# EAGLE board LG08.v1.0.2 (EAGLE 7.5.0)
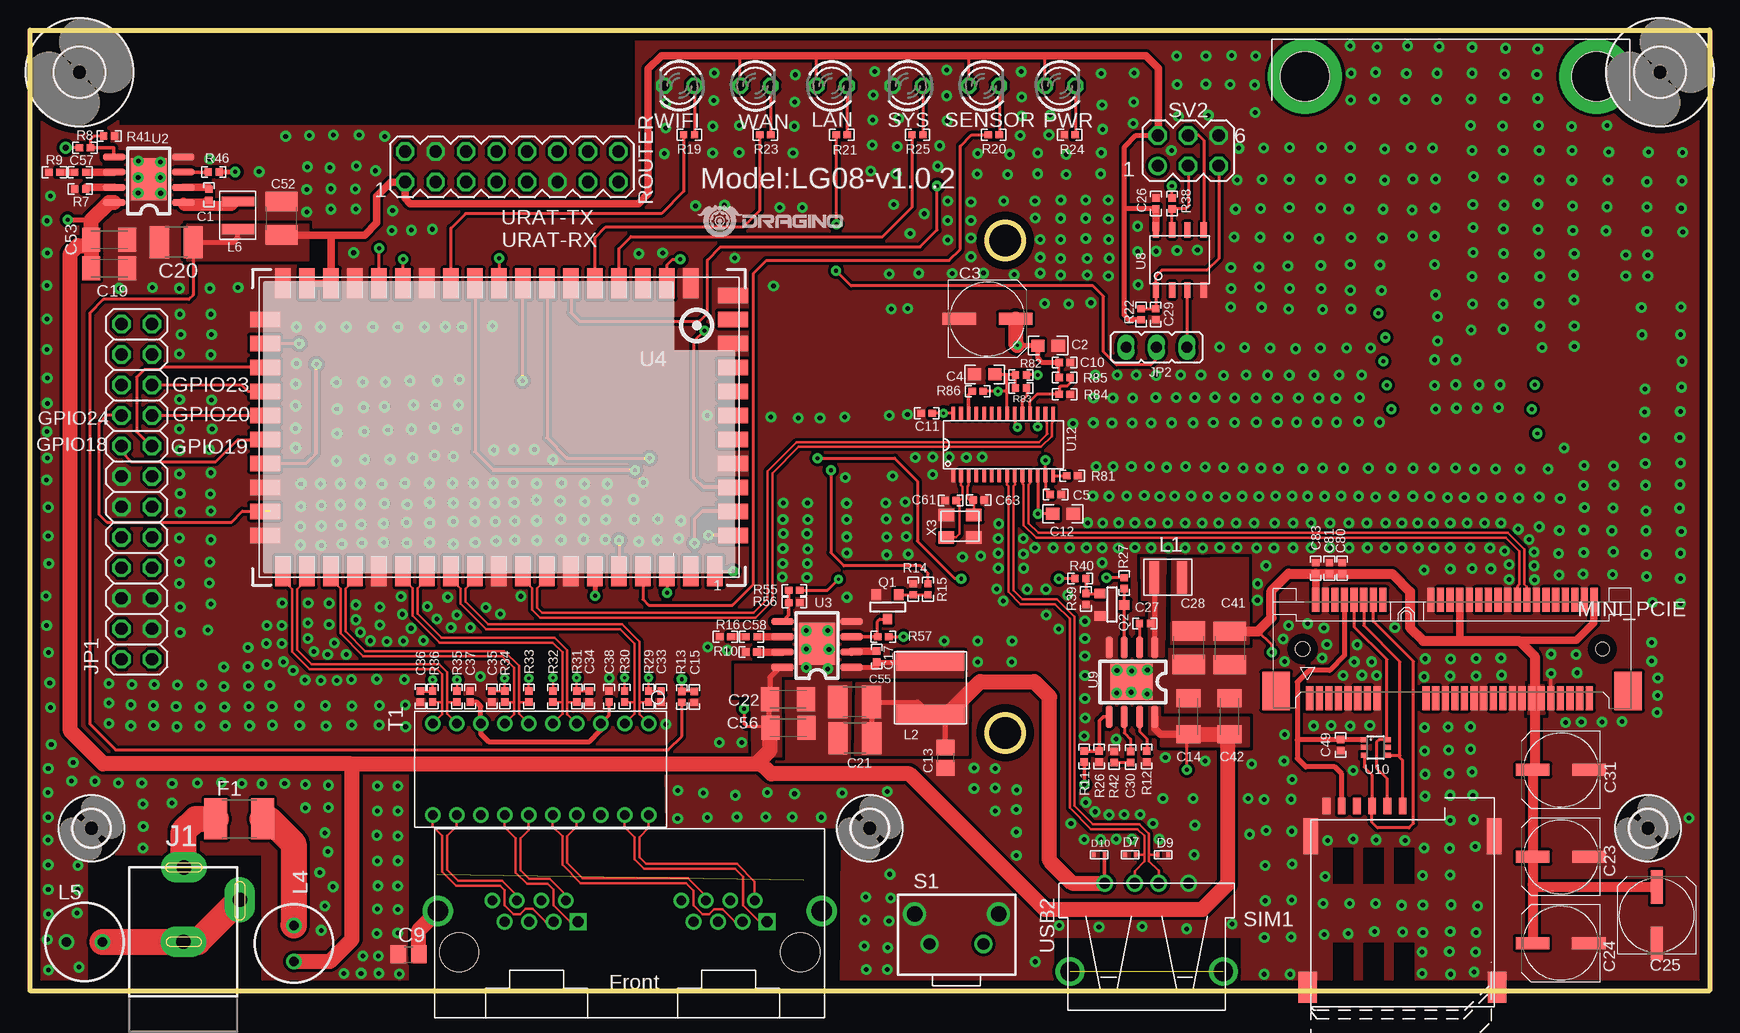
[diagram p6: board, top side]
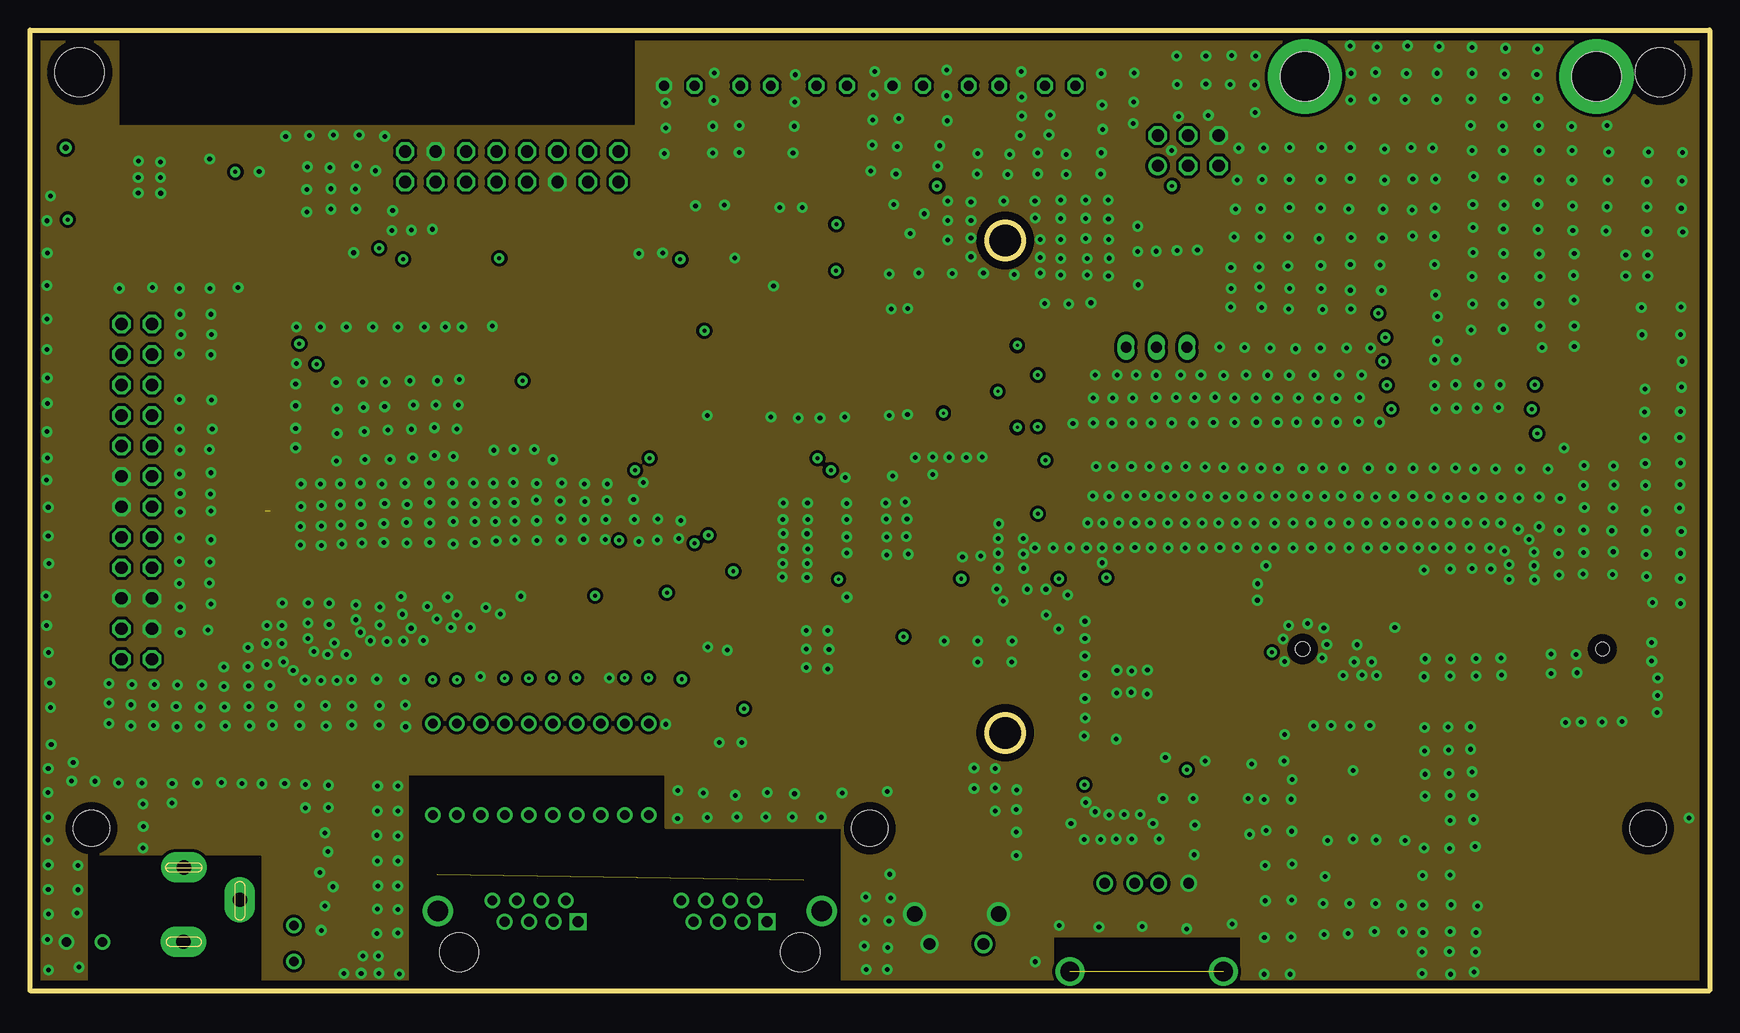
[diagram p7: board, inner layer Route2]
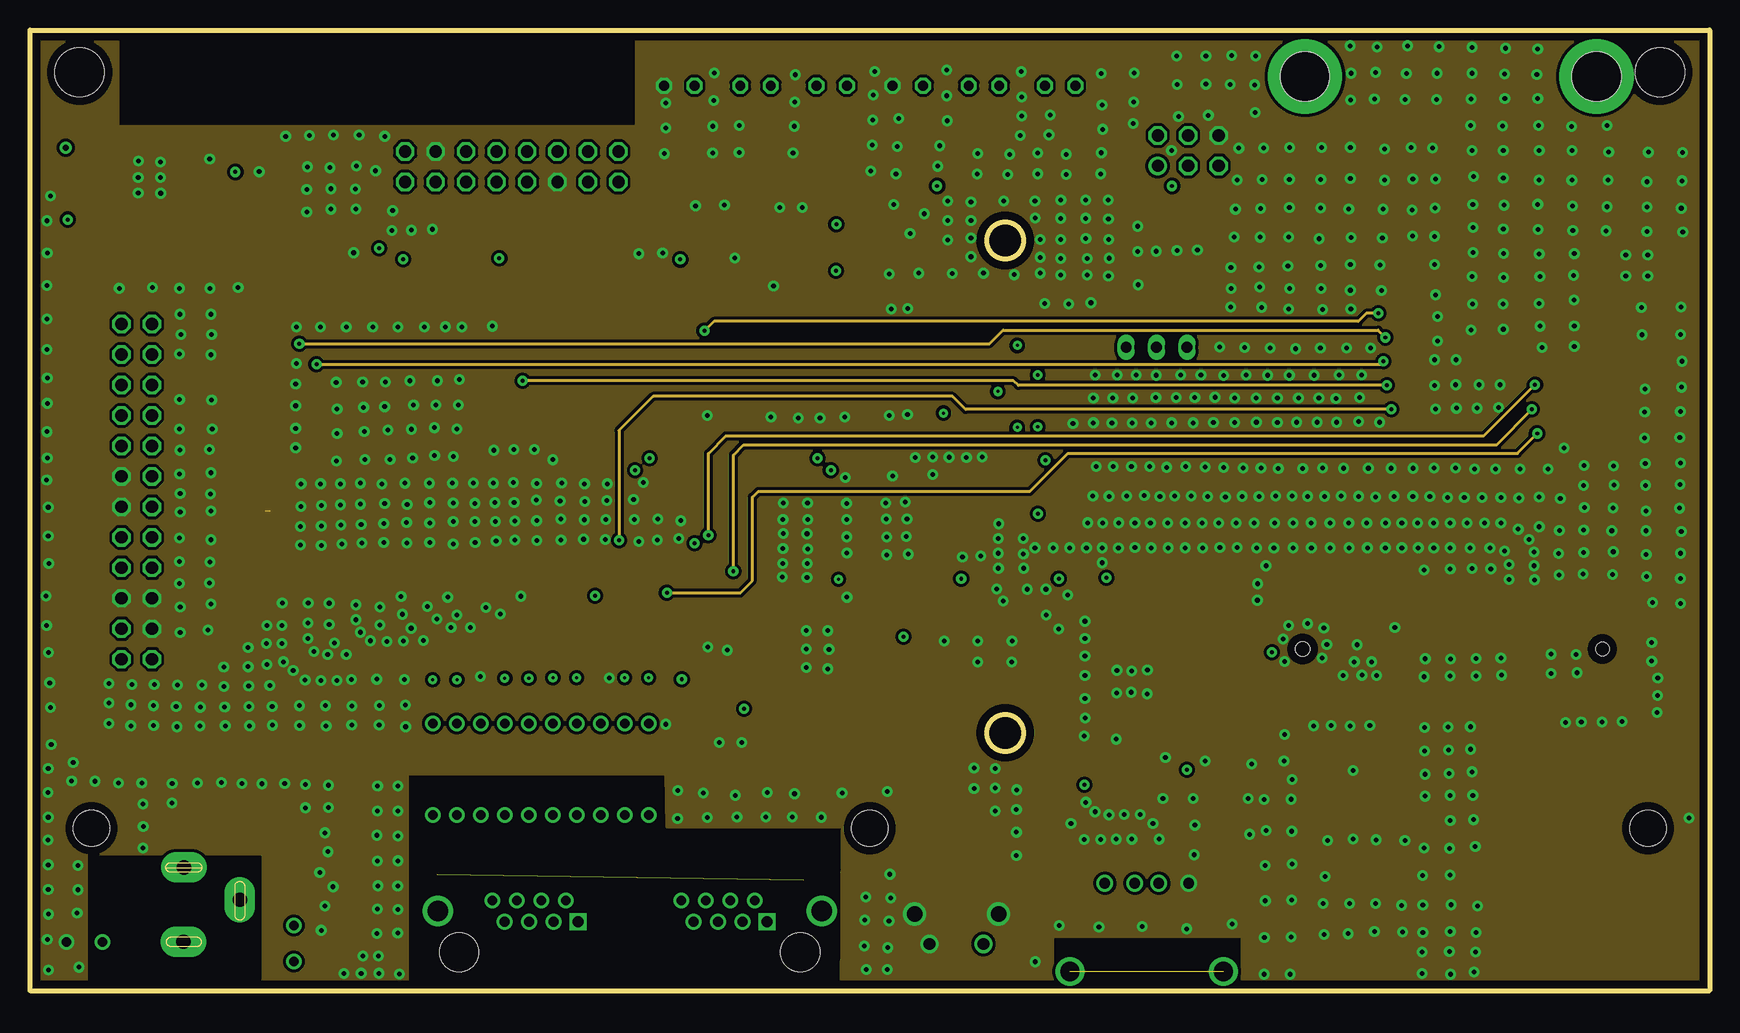
[diagram p8: board, inner layer Route15]
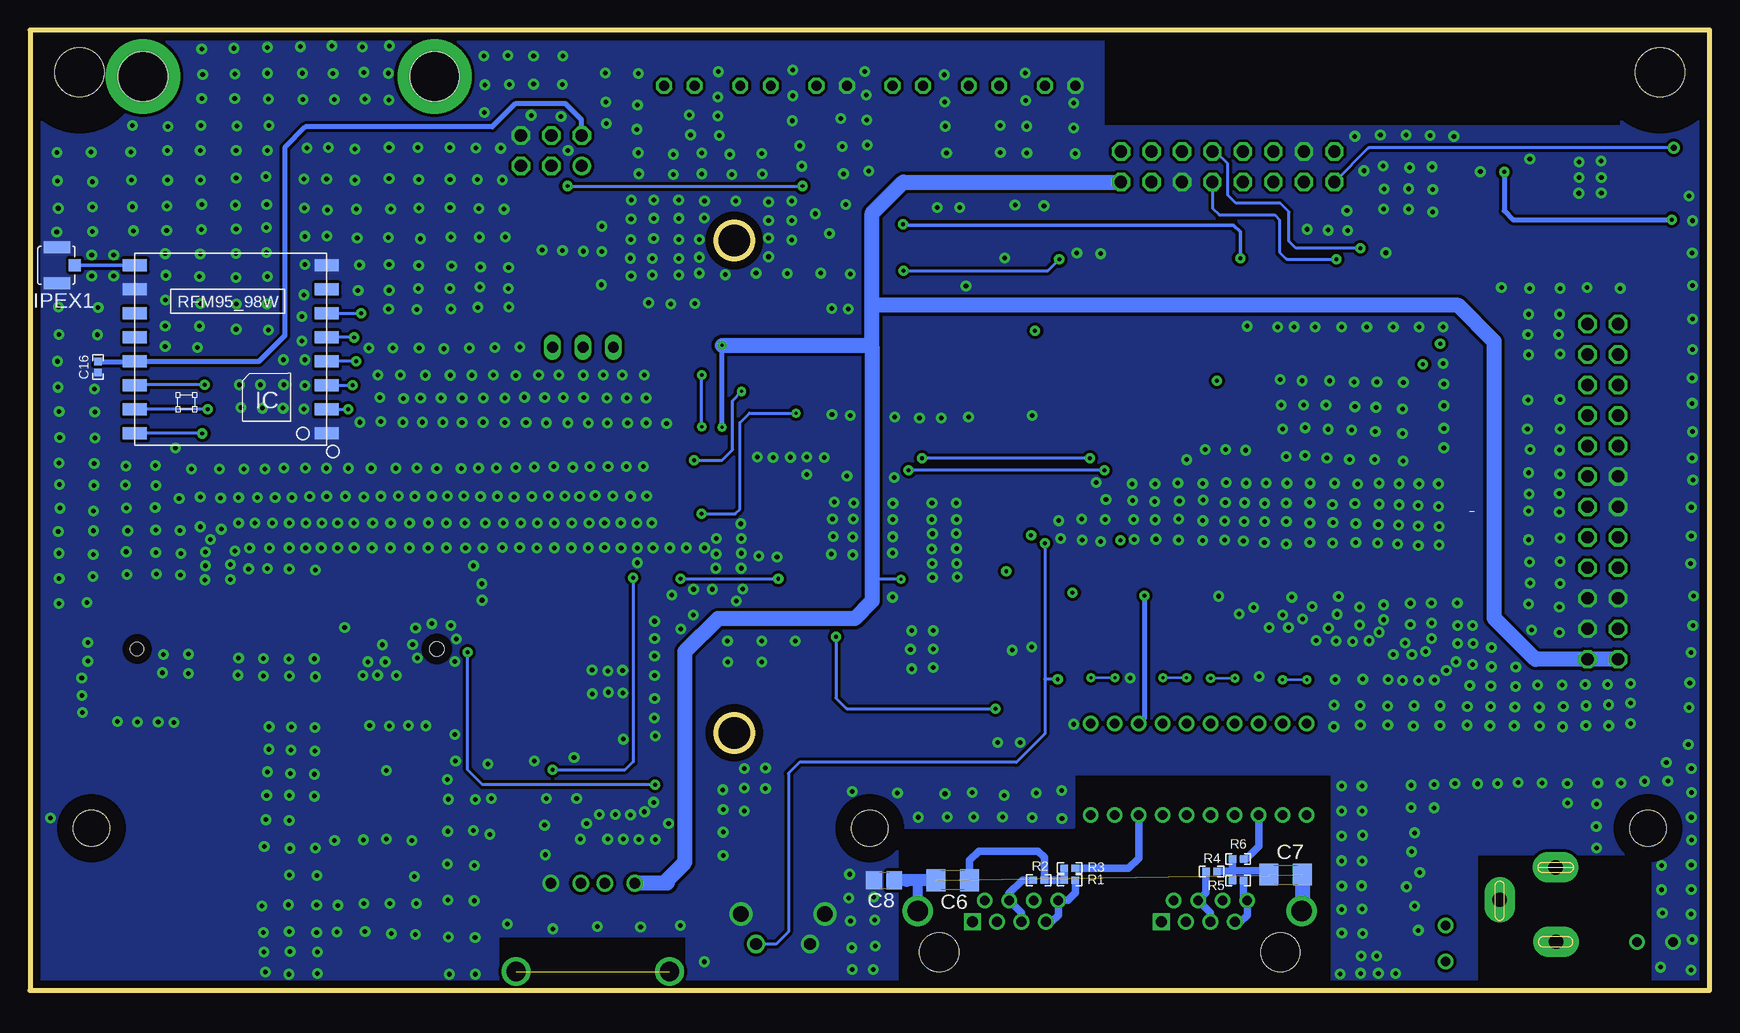
[diagram p9: board, bottom side, seen from below]

Size 140 x 80.05 mm. Coordinates in mm from the lower left corner, seen from the top.
Outline: 0,0 140,0 140,80.05 0,80.05 0,0
Outline: circle at 81.28,21.48 radius 1.52
Outline: circle at 81.28,62.5 radius 1.52
Copper layers (1*2+15*16): Top 0.035mm / dielectric 1.5mm / Route2 0.035mm / dielectric 0.15mm / Route15 0.035mm / dielectric 0.2mm / Bottom 0.035mm
Design rules "default *": minimum track width 5mil, minimum drill 10mil, track to track 8mil, track to pad 8mil, pad to pad 8mil, via to via 10mil, smd to smd 8mil, copper to edge 26mil, drill to drill 10mil, minimum pad ring 10mil, minimum via ring 10mil, stop-mask expansion 1mil, vias tented up to drill 30mil, thermal gap 10mil
Net classes: 0 default: clearance 0.205 mm; 1 2layer-50ohm: width 1 mm, clearance 0.2 mm; 2 gnd: width 0.305 mm, drill 0.33 mm, clearance 0.254 mm; 3 usbvcc: width 0.508 mm, drill 0.61 mm, clearance 0.254 mm; 4 aref: width 0.406 mm, drill 0.61 mm, clearance 0.254 mm; 6 usbtrace-4layer: width 0.191 mm, clearance 0.203 mm

## Footprints (pad centres in the part's own frame; a part is rotated, then mirrored left to right if it is on the bottom)
C0402 = smd 0.61 x 0.61: 1 -0.457,0; 2 0.457,0
C0603 = smd 1.1 x 1: 1 -0.85,0; 2 0.85,0
UD-6,3X5,8_NICHICON = smd 2.8 x 1: + 2.35,0; - -2.35,0
C1206 = smd 1.6 x 1.8: 1 -1.4,0; 2 1.4,0
C0805 = smd 1.3 x 1.5: 1 -0.85,0; 2 0.85,0
C1206K = smd 1.5 x 2: 1 -1.5,0; 2 1.5,0
C1210 = smd 1.6 x 2.7: 1 -1.4,0; 2 1.4,0
SOD−923 = smd 0.3 x 0.4: P$1 -0.45,0; P$2 0.45,0
L1812 = smd 1.9 x 3.4: 1 -1.95,0; 2 1.95,0
I-PEX = smd 1 x 2.2: GND -1.65,-0.27; GND1 1.35,-0.27 | smd 1 x 1: SIG -0.15,-1.77
POWER_JACK_SLOT = drill 1.2 pad 2.54 long: GND@1 0,0; GND@2 4.7,3.5; PWR 0.04,6.2
ETHERNET-1X2 = drill 0.94 pad 1.27 square: 1-1 4.305,-2.54; 2-1 -11.445,-2.54 | drill 0.8: 1-2 5.325,-4.32; 1-3 6.345,-2.54; 1-4 7.365,-4.32; 1-5 8.385,-2.54; 1-6 9.405,-4.32; 1-7 10.425,-2.54; 1-8 11.445,-4.32; 2-2 -10.425,-4.32; 2-3 -9.405,-2.54; 2-4 -8.385,-4.32; 2-5 -7.365,-2.54; 2-6 -6.345,-4.32; 2-7 -5.325,-2.54; 2-8 -4.305,-4.32 | drill 1.7: S1 16,-3.43; S2 -16,-3.43 | hole 3.25: -14.225,0; 14.225,0
2X12 = drill 1.016 octagon: 1 -13.97,-1.27; 2 -13.97,1.27; 3 -11.43,-1.27; 4 -11.43,1.27; 5 -8.89,-1.27; 6 -8.89,1.27; 7 -6.35,-1.27; 8 -6.35,1.27; 9 -3.81,-1.27; 10 -3.81,1.27; 11 -1.27,-1.27; 12 -1.27,1.27; 13 1.27,-1.27; 14 1.27,1.27; 15 3.81,-1.27; 16 3.81,1.27; 17 6.35,-1.27; 18 6.35,1.27; 19 8.89,-1.27; 20 8.89,1.27; 21 11.43,-1.27; 22 11.43,1.27; 23 13.97,-1.27; 24 13.97,1.27
JP2 = drill 0.914 long: 1 -2.54,0; 2 0,0; 3 2.54,0
SWPA3010S = smd 0.8 x 2.7: P$1 -1.15,0; P$2 1.15,0
SWPA6028S = smd 5.7 x 1.7: P$1 0,2.25; P$2 0,-2.25
BS11 = drill 0.8: 1 -1.5,0; 2 1.5,0
LED3MM = drill 0.813 octagon: A -1.27,0; K 1.27,0
679105700 = smd 0.6 x 2: 1 0.6,-4.1; 2 1.1,4.1; 3 1.4,-4.1; 4 1.9,4.1; 5 2.2,-4.1; 6 2.7,4.1; 7 3,-4.1; 8 3.5,4.1; 9 3.8,-4.1; 10 4.3,4.1; 11 4.6,-4.1; 12 5.1,4.1; 13 5.4,-4.1; 14 5.9,4.1; 15 6.2,-4.1; 16 6.7,4.1; 17 10.3,-4.1; 18 10.7,4.1; 19 11.1,-4.1; 20 11.5,4.1; 21 11.9,-4.1; 22 12.3,4.1; 23 12.7,-4.1; 24 13.1,4.1; 25 13.5,-4.1; 26 13.9,4.1; 27 14.3,-4.1; 28 14.7,4.1; 29 15.1,-4.1; 30 15.5,4.1; 31 15.9,-4.1; 32 16.3,4.1; 33 16.7,-4.1; 34 17.1,4.1; 35 17.5,-4.1; 36 17.9,4.1; 37 18.3,-4.1; 38 18.7,4.1; 39 19.1,-4.1; 40 19.5,4.1; 41 19.9,-4.1; 42 20.3,4.1; 43 20.7,-4.1; 44 21.1,4.1; 45 21.5,-4.1; 46 21.9,4.1; 47 22.3,-4.1; 48 22.7,4.1; 49 23.1,-4.1; 50 23.5,4.1; 51 23.9,-4.1; 52 24.3,4.1 | drill 4.09 pad 6.2: 53 0.2,47.7; 54 24.5,47.7 | smd 2.3 x 3.2: M1 27.15,-3.5; M2 -2.2,-3.5 | hole 1.2: 0,0 | hole 1.1: 25,0 | hole 4.09: 0.2,47.7; 24.5,47.7
SOT-23 = smd 0.787 x 0.889: 1 0,-1.016; 2 -0.95,1.016; 3 0.95,1.016
R0402 = smd 0.61 x 0.61: 1 -0.457,0; 2 0.457,0
MA08-2 = drill 1.016 octagon: 1 -8.89,-1.27; 2 -8.89,1.27; 3 -6.35,-1.27; 4 -6.35,1.27; 5 -3.81,-1.27; 6 -3.81,1.27; 7 -1.27,-1.27; 8 -1.27,1.27; 9 1.27,-1.27; 10 1.27,1.27; 11 3.81,-1.27; 12 3.81,1.27; 13 6.35,-1.27; 14 6.35,1.27; 15 8.89,-1.27; 16 8.89,1.27
SWITCH_6X6X5 = drill 0.991 pad 1.524: 1 -2.25,0; 2 2.25,0 | drill 1.295 pad 1.905: 3 3.5,2.5; 4 -3.5,2.5
SIM-MICRO-PUSH = smd 0.65 x 1.35: CLK 7.91,15.105; GND 1.56,15.105; IO 6.64,15.105; RST 5.37,15.105; VCC 2.83,15.105; VPP 4.1,15.105 | smd 1.55 x 2.6: P$1 0,0; P$2 15.8,0 | smd 1.2 x 3: P$3 15.55,12.58; P$4 0.25,12.58
MA03-2 = drill 1.016: 1 -2.54,-1.27 | drill 1.016 octagon: 2 -2.54,1.27; 3 0,-1.27; 4 0,1.27; 5 2.54,-1.27; 6 2.54,1.27
RIONET_H2038 = drill 0.8: 1 -3.81,9; 2 -3.81,7; 3 -3.81,5; 4 -3.81,3; 5 -3.81,1; 6 -3.81,-1; 7 -3.81,-3; 8 -3.81,-5; 9 -3.81,-7; 10 -3.81,-9; 11 3.81,-9; 12 3.81,-7; 13 3.81,-5; 14 3.81,-3; 15 3.81,-1; 16 3.81,1; 17 3.81,3; 18 3.81,5; 19 3.81,7; 20 3.81,9
RFM92_93W = smd 2 x 1: 1 -8,7; 2 -8,5; 3 -8,3; 4 -8,1; 5 -8,-1; 6 -8,-3; 7 -8,-5; 8 -8,-7; 9 8,-7; 10 8,-5; 11 8,-3; 12 8,-1; 13 8,1; 14 8,3; 15 8,5; 16 8,7
RT8250-SOP8 = smd 1.88 x 0.61: 1 -1.219,0; 2 -1.219,-1.27; 3 -1.219,-2.54; 4 -1.219,-3.81; 5 4.547,-3.81; 6 4.547,-2.54; 7 4.547,-1.27; 8 4.547,0 | smd 2.997 x 3.505: 9 1.651,-1.956
HE-4025 = smd 1.3 x 2.5: 1 -18,12; 2 -16,12; 3 -14,12; 4 -12,12; 5 -10,12; 6 -8,12; 7 -6,12; 8 -4,12; 9 -2,12; 10 0,12; 11 2,12; 12 4,12; 13 6,12; 14 8,12; 15 10,12; 16 12,12; 17 14,12; 18 16,12; 19 18,12; 30 18,-12; 31 16,-12; 32 14,-12; 33 12,-12; 34 10,-12; 35 8,-12; 36 6,-12; 37 4,-12; 38 2,-12; 39 0,-12; 40 -2,-12; 41 -4,-12; 42 -6,-12; 43 -8,-12; 44 -10,-12; 45 -12,-12; 46 -14,-12; 47 -16,-12 | smd 2.5 x 1.3: 20 19.5,9; 21 19.5,7; 22 19.5,5; 23 19.5,3; 24 19.5,1; 25 19.5,-1; 26 19.5,-3; 27 19.5,-5; 28 19.5,-7; 29 19.5,-9; 48 -19.5,-11; 49 -19.5,-9; 50 -19.5,-7; 51 -19.5,-5; 52 -19.5,-3; 53 -19.5,-1; 54 -19.5,1; 55 -19.5,3; 56 -19.5,5; 57 -19.5,7; 58 -19.5,9
S8S1 = smd 1.27 x 0.51: 1 -0.54,5.47; 2 -0.54,4.11; 3 -0.54,2.84; 4 -0.54,1.48; 5 4.46,1.48; 6 4.46,2.84; 7 4.46,4.11; 8 4.46,5.47
SOT363 = smd 0.42 x 0.6: 1 -0.65,-0.95; 2 0,-0.95; 3 0.65,-0.95; 4 0.65,0.95; 5 0,0.95; 6 -0.65,0.95
USB_HUB_FE1.1S = smd 0.3 x 1.1: 1 -4.16,-2.6; 2 -3.52,-2.6; 3 -2.88,-2.6; 4 -2.24,-2.6; 5 -1.6,-2.6; 6 -0.96,-2.6; 7 -0.32,-2.6; 8 0.32,-2.6; 9 0.96,-2.6; 10 1.6,-2.6; 11 2.24,-2.6; 12 2.88,-2.6; 13 3.52,-2.6; 14 4.16,-2.6; 15 4.16,2.62; 16 3.52,2.62; 17 2.88,2.62; 18 2.24,2.62; 19 1.6,2.62; 20 0.96,2.62; 21 0.32,2.62; 22 -0.32,2.62; 23 -0.96,2.62; 24 -1.6,2.62; 25 -2.24,2.62; 26 -2.88,2.62; 27 -3.52,2.62; 28 -4.16,2.62
3,0 = hole 3: 0,0
4,1 = hole 4.1: 0,0
USB_C42562 = drill 0.9: 1 -3.5,5.29; 2 -1,5.29; 3 1,5.29; 4 3.5,5.29 | drill 1.6: 5 -6.4,-2.06; 6 6.4,-2.06
SMARTPRJ_CRYSTAL-3.2-2.5 = smd 1.3 x 1.05: 1 -1.15,-0.925; 2 1.15,-0.925; 3 1.15,0.925; 4 -1.15,0.925

## Placement (x,y rotation side)
C1  0.1u,50v  [C0402]  14.91,66.32 270 top
C2  10uf 10v  [C0603]  84.86,53.76 0 top
C3  100uF 16v TBD  [UD-6,3X5,8_NICHICON]  79.81,55.97 0 top
C4  10uf 10v  [C0603]  79.58,51.35 180 top
C5  0.1u  [C0402]  85.5,41.34 0 top
C6  1000pF,2kv  [C1206]  63.09,9.2 180 bottom
C7  1000pF,2kv  [C1206]  35.34,9.67 0 bottom
C8  0.1u,100V  [C0805]  68.79,9.19 0 bottom
C9  0.1u,100V  [C0805]  31.55,3.01 0 top
C10  0.1u  [C0402]  86.24,52.35 0 top
C11  0.1u  [C0402]  74.75,48.12 180 top
C12  10uf 10v  [C0603]  86.1,39.74 0 top
C13  10u,10V  [C0805]  76.3,19.4 270 top
C14  10uf,50v  [C1206K]  96.55,22.85 90 top
C15  100nF  [C0402]  55.37,24.48 90 top
C16  0.1uF 10V  [C0402]  134.34,51.96 90 bottom
C17  0.1u,50v  [C0402]  70.59,27.83 270 top
C19  10uf,50v  [C1206K]  6.6,60.2 0 top
C20  22uF,10v  [C1210]  12.19,62.36 180 top
C21  22uf,10v  [C1210]  68.76,21.03 180 top
C22  10uf,50v  [C1206K]  63.2,24.28 0 top
C23  470uF,JLC-C116423  [UD-6,3X5,8_NICHICON]  127.61,11.15 180 top
C24  470uF,JLC-C116423  [UD-6,3X5,8_NICHICON]  127.59,3.96 180 top
C25  470uF,JLC-C116423  [UD-6,3X5,8_NICHICON]  135.59,6.27 90 top
C26  0.1uF,25V  [C0402]  93.86,65.6 270 top
C27  0.1u,50v  [C0402]  92.94,30.6 0 top
C28  22fu,10v  [C1210]  96.57,28.57 270 top
C29  100pF  [C0402]  93.83,56.36 90 top
C30  2.7nf  [C0402]  91.75,19.48 90 top
C31  470uF,JLC-C116423  [UD-6,3X5,8_NICHICON]  127.61,18.38 180 top
C33  0.1u 10v  [C0402]  52.61,24.5 270 top
C34  0.1u 10v  [C0402]  46.61,24.5 270 top
C35  0.1u 10v  [C0402]  38.51,24.5 270 top
C36  0.1u 10v  [C0402]  32.54,24.5 270 top
C37  0.1u  [C0402]  36.68,24.5 90 top
C38  0.1u  [C0402]  48.26,24.5 90 top
C41  22uf,10v  [C1210]  100,28.54 270 top
C42  10uf,50v  [C1206K]  99.98,22.85 90 top
C49  0.1u  [C0402]  109.25,20.47 270 top
C52  22uF,10v  [C1210]  20.98,64.37 90 top
C53  10uf,50v  [C1206K]  6.6,62.56 0 top
C55  22fu,10v  [C1210]  68.74,24.05 180 top
C56  10uf,50v  [C1206K]  63.22,21.89 0 top
C57  2.7nf  [C0402]  4.19,68.2 0 top
C58  2.7nf  [C0402]  60.15,29.48 0 top
C61  18pF  [C0402]  76.76,40.86 0 top
C63  18pF  [C0402]  79.09,40.88 180 top
C80  33pf  [C0402]  109.38,35.2 90 top
C81  10pf  [C0402]  108.31,35.2 90 top
C83  33pf  [C0402]  107.17,35.2 90 top
D7  ESD7951ST5G  [SOD−923]  91.72,11.32 0 top
D9  ESD7951ST5G  [SOD−923]  94.44,11.32 180 top
D10  ESD7951ST5G  [SOD−923]  89.13,11.32 0 top
F1  2A  [L1812]  17.44,14.32 0 top
IPEX1  I-PEX  [I-PEX]  138.03,60.6 90 bottom
J1  POWER_JACKSLT  [POWER_JACK_SLOT]  12.79,4.07 0 top
J2  ETHERNET_2PORT  [ETHERNET-1X2]  49.99,3.2 180 top
JP1  [2X12]  8.9,41.58 90 top
JP2  [JP2]  93.91,53.61 0 top
L1  4.7uH /SWPA3015S4R7MT  [SWPA3010S]  94.87,34.44 0 top
L2  6.8uH / SWPA6045S6R8MT  [SWPA6028S]  75.06,25.24 0 top
L4  bead  [BS11]  22,3.93 90 top
L5  bead  [BS11]  4.55,4.06 0 top
L6  4.7uH /SWPA3015S4R7MT  [SWPA3010S]  17.32,64.59 270 top
LAN  GREEN  [LED3MM]  66.82,75.4 0 top
MINI_PCIE  f5521gw  [679105700]  106.07,28.47 0 top
PWR  GREEN  [LED3MM]  85.87,75.4 0 top
Q1  BSS138-7-F  [SOT-23]  71.48,31.97 0 top
Q2  BSS138-7-F  [SOT-23]  90.2,32.15 90 top
R1  75  [R0402]  53.32,9.2 0 bottom
R2  75  [R0402]  55.91,9.2 180 bottom
R3  75  [R0402]  53.32,10.2 180 bottom
R4  75  [R0402]  41.51,9.93 180 bottom
R5  75  [R0402]  39.3,9.16 0 bottom
R6  75  [R0402]  39.3,10.97 180 bottom
R7  180K  [R0402]  4.19,66.8 180 top
R8  75K 1%  [R0402]  4.57,70.23 180 top
R9  16K 1%  [R0402]  2.03,68.2 0 top
R10  180K  [R0402]  60.12,28.21 180 top
R11  75K 1%  [R0402]  87.89,19.5 270 top
R12  180K  [R0402]  93.09,19.5 270 top
R13  330  [R0402]  54.33,24.48 90 top
R14  47K,NL  [R0402]  73.64,33.45 270 top
R15  4.7k  [R0402]  74.86,33.45 270 top
R16  24K  [R0402]  57.97,29.48 180 top
R19  270  [R0402]  54.94,71.32 0 top
R20  330  [R0402]  80.34,71.32 0 top
R21  330  [R0402]  67.66,71.32 0 top
R22  10K  [R0402]  92.64,56.36 270 top
R23  330  [R0402]  61.28,71.32 0 top
R24  330  [R0402]  86.68,71.32 0 top
R25  270  [R0402]  73.98,71.32 0 top
R26  24K 1%  [R0402]  89.13,19.5 90 top
R27  100K  [R0402]  91.21,33.95 90 top
R29  49.9  [R0402]  51.57,24.5 90 top
R30  49.9  [R0402]  49.56,24.5 90 top
R31  49.9  [R0402]  45.57,24.5 90 top
R32  49.9  [R0402]  43.59,24.5 90 top
R33  49.9  [R0402]  41.58,24.5 90 top
R34  49.9  [R0402]  39.58,24.5 90 top
R35  49.9  [R0402]  35.59,24.5 90 top
R36  49.9  [R0402]  33.56,24.5 90 top
R38  0R  [R0402]  95.2,65.6 270 top
R39  47K,NL  [R0402]  88.01,32.63 90 top
R40  4.7k  [R0402]  87.56,34.34 0 top
R41  24K 1%  [R0402]  6.61,71.21 180 top
R42  16K  [R0402]  90.38,19.48 90 top
R46  100K  [R0402]  15.32,68.23 180 top
R55  53.6K 1%  [R0402]  63.71,33.37 0 top
R56  10K 1%  [R0402]  63.71,32.33 180 top
R57  100K  [R0402]  71.12,29.48 0 top
R81  2.7K 1%  [R0402]  86.87,42.9 180 top
R82  100k  [R0402]  82.61,51.31 180 top
R83  100k  [R0402]  82.61,50.22 180 top
R84  100k  [R0402]  86.26,49.69 180 top
R85  47K  [R0402]  86.24,51.08 180 top
R86  100k  [R0402]  78.99,49.95 0 top
ROUTER  [MA08-2]  40.16,68.65 0 top
S1  [SWITCH_6X6X5]  77.23,3.89 0 top
SENSOR  GREEN  [LED3MM]  79.52,75.4 0 top
SIM1  SIM_CARD_CON_6MICRO  [SIM-MICRO-PUSH]  106.51,0.27 0 top
SV2  [MA03-2]  96.55,70 0 top
SYS  GREEN  [LED3MM]  73.17,75.4 180 top
T1  RJ45_TRANSFORMER_HST2038DR  [RIONET_H2038]  42.57,18.44 270 top
U1  RFM92_93W  [RFM92_93W]  123.27,53.44 180 bottom
U2  RT7272  [RT8250-SOP8]  11.56,65.66 180 top
U3  RT7272  [RT8250-SOP8]  67.26,26.94 180 top
U4  HE-4025  [HE-4025]  39.09,46.93 180 top
U8  ATTINY13  [S8S1]  99.32,58.92 90 top
U9  RT7272  [RT8250-SOP8]  93.75,27.38 270 top
U10  SMF05C  [SOT363]  112.17,20.26 270 top
U12  USB_HUB_FE1.1S  [USB_HUB_FE1.1S]  81.13,45.5 0 top
U$2  [SMA-JACK]  9.43,18.56 270 top
U$6  [3,0]  134.87,13.52 0 top
U$7  [LOGO-DRAGINO-2018]  55.65,62.81 0 top
U$8  [4,1]  135.87,76.53 0 top
U$10  [3,0]  5.13,13.52 0 top
U$13  [3,0]  70,13.52 0 top
U$14  [4,1]  4.13,76.53 0 top
USB2  USB_C42562  [USB_C42562]  93.09,3.65 0 top
WAN  GREEN  [LED3MM]  60.47,75.4 0 top
WIFI  GREEN  [LED3MM]  54.12,75.4 180 top
X3  12Mhz,X322512MMB4SI  [SMARTPRJ_CRYSTAL-3.2-2.5]  77.52,38.7 180 top

## Tracks (layer width: path | path; a pad name or v marks a point on that pad's centre or on a via)
2.0V_CTL  (via drill 0.33)
  Top 0.305: C38.1 48.26,22.94 T1.3
  Top 0.406: C37.1 37.21,24.05 37.57,23.69 T1.8 37.57,21.4 38.23,20.75 46.64,20.75 47.58,21.69 T1.3 | U4.6 v47.09,32.91
  Bottom 0.406: v47.09,32.91 47.09,22.73 T1.3
+3V3  (via drill 0.5)
  Top 0.254: WAN.A 59.2,77.86 59.24,77.9 | LAN.A 65.55,77.6 65.26,77.9 | SENSOR.A 78.25,77.71 78.44,77.9 | PWR.A 84.6,77.86 84.64,77.9 | R8.2 v2.98,70.23 v2.97,70.23 | C20.1 13.59,57.96 13.24,57.6 6.12,57.6 4.98,56.46 4.98,22.22 7.14,20.06 53.19,20.06 54.33,21.2 R13.1
  Top 0.406: C20.1 16.95,62.36 17.33,62.73 L6.P$2 | R22.2 91.62,55.9 91.21,56.31 91.21,65.17 | 91.21,65.17 91.21,70.28 92.2,71.27 SV2.2 | 93.85,65.14 91.25,65.14 91.21,65.17
  Top 0.61: U8.8 93.85,65.14 C26.2 | SV2.2 94.06,71.32 94.06,76.85 93.02,77.9 84.64,77.9 78.44,77.9 65.26,77.9 59.24,77.9 52.63,77.9 51.54,76.8 51.54,66.39 50.73,65.58 31.7,65.58 31.27,66.01 ROUTER.1 30.08,67.38 28.91,66.21 28.91,63.98 27.9,62.97 25.28,62.97 | C52.1 25.28,62.97 | 25.28,62.97 25.09,62.78 U4.32 U4.31
  Bottom 0.254: v2.97,70.23 28.43,70.23 ROUTER.1
  Bottom 0.406: C16.2 131.29,52.42 U1.13 120.92,52.44 118.75,54.6 118.75,70.28 117.05,71.98 101.48,71.98 99.52,73.93 95.38,73.93 94.06,72.61 94.06,71.32 SV2.2
  pour Top (no thermals): 13.08,63.88 13.08,60.84 23.24,60.81 23.24,63.86
+5V  (via drill 0.25)
  Top 0.254: U12.20 82.09,47.15 v82.3,46.93 | R85.2 C10.1 | R55.2 66.47,33.37 v67.39,34.28
  Top 0.305: D10.P$2 USB2.1
  Top 0.406: v82.3,53.77 C2.1 84,52.72 84.37,52.35 C10.1 | C13.1 76.3,23.18 76.11,22.99 L2.P$2 74,24.05 C55.1 70.14,21.23 70.16,21.2 C21.1
  Top 1.27: C3.+ 82.16,53.91 v82.3,53.77 | USB2.1 89.57,8.96 86.87,8.96 84.99,10.84 84.99,24.48 83.72,25.75 79.2,25.75 76.63,23.18 76.3,23.18
  Bottom 0.254: v67.39,34.28 69.78,34.28 69.8,34.26
  Bottom 0.406: v82.3,46.93 v82.3,53.77
  Bottom 1.27: JP1.2 JP1.1 14.51,27.61 17.96,31.06 17.96,54.12 20.93,57.09 69.57,57.09 69.8,57.32 | v82.3,53.77 70.01,53.77 69.8,53.56 | 69.8,53.56 69.8,34.26 69.8,32.46 71.25,31.01 82.65,31.01 85.4,28.26 85.4,10.71 87.15,8.96 | 86.87,8.96 87.15,8.96 | 87.15,8.96 89.57,8.96 USB2.1 | 69.8,53.56 69.8,57.32 | 69.8,57.32 69.8,64.79 67.21,67.38 ROUTER.15
  pour Top (no thermals): 68.84,25.65 78.23,25.67 78.18,19.63 68.71,19.6